# EasyEDA Pro project ProPrj_Avaota A1 八核 AIoT 开发板_2024-05-20.epro, board 点位_BOTTOM (continued)
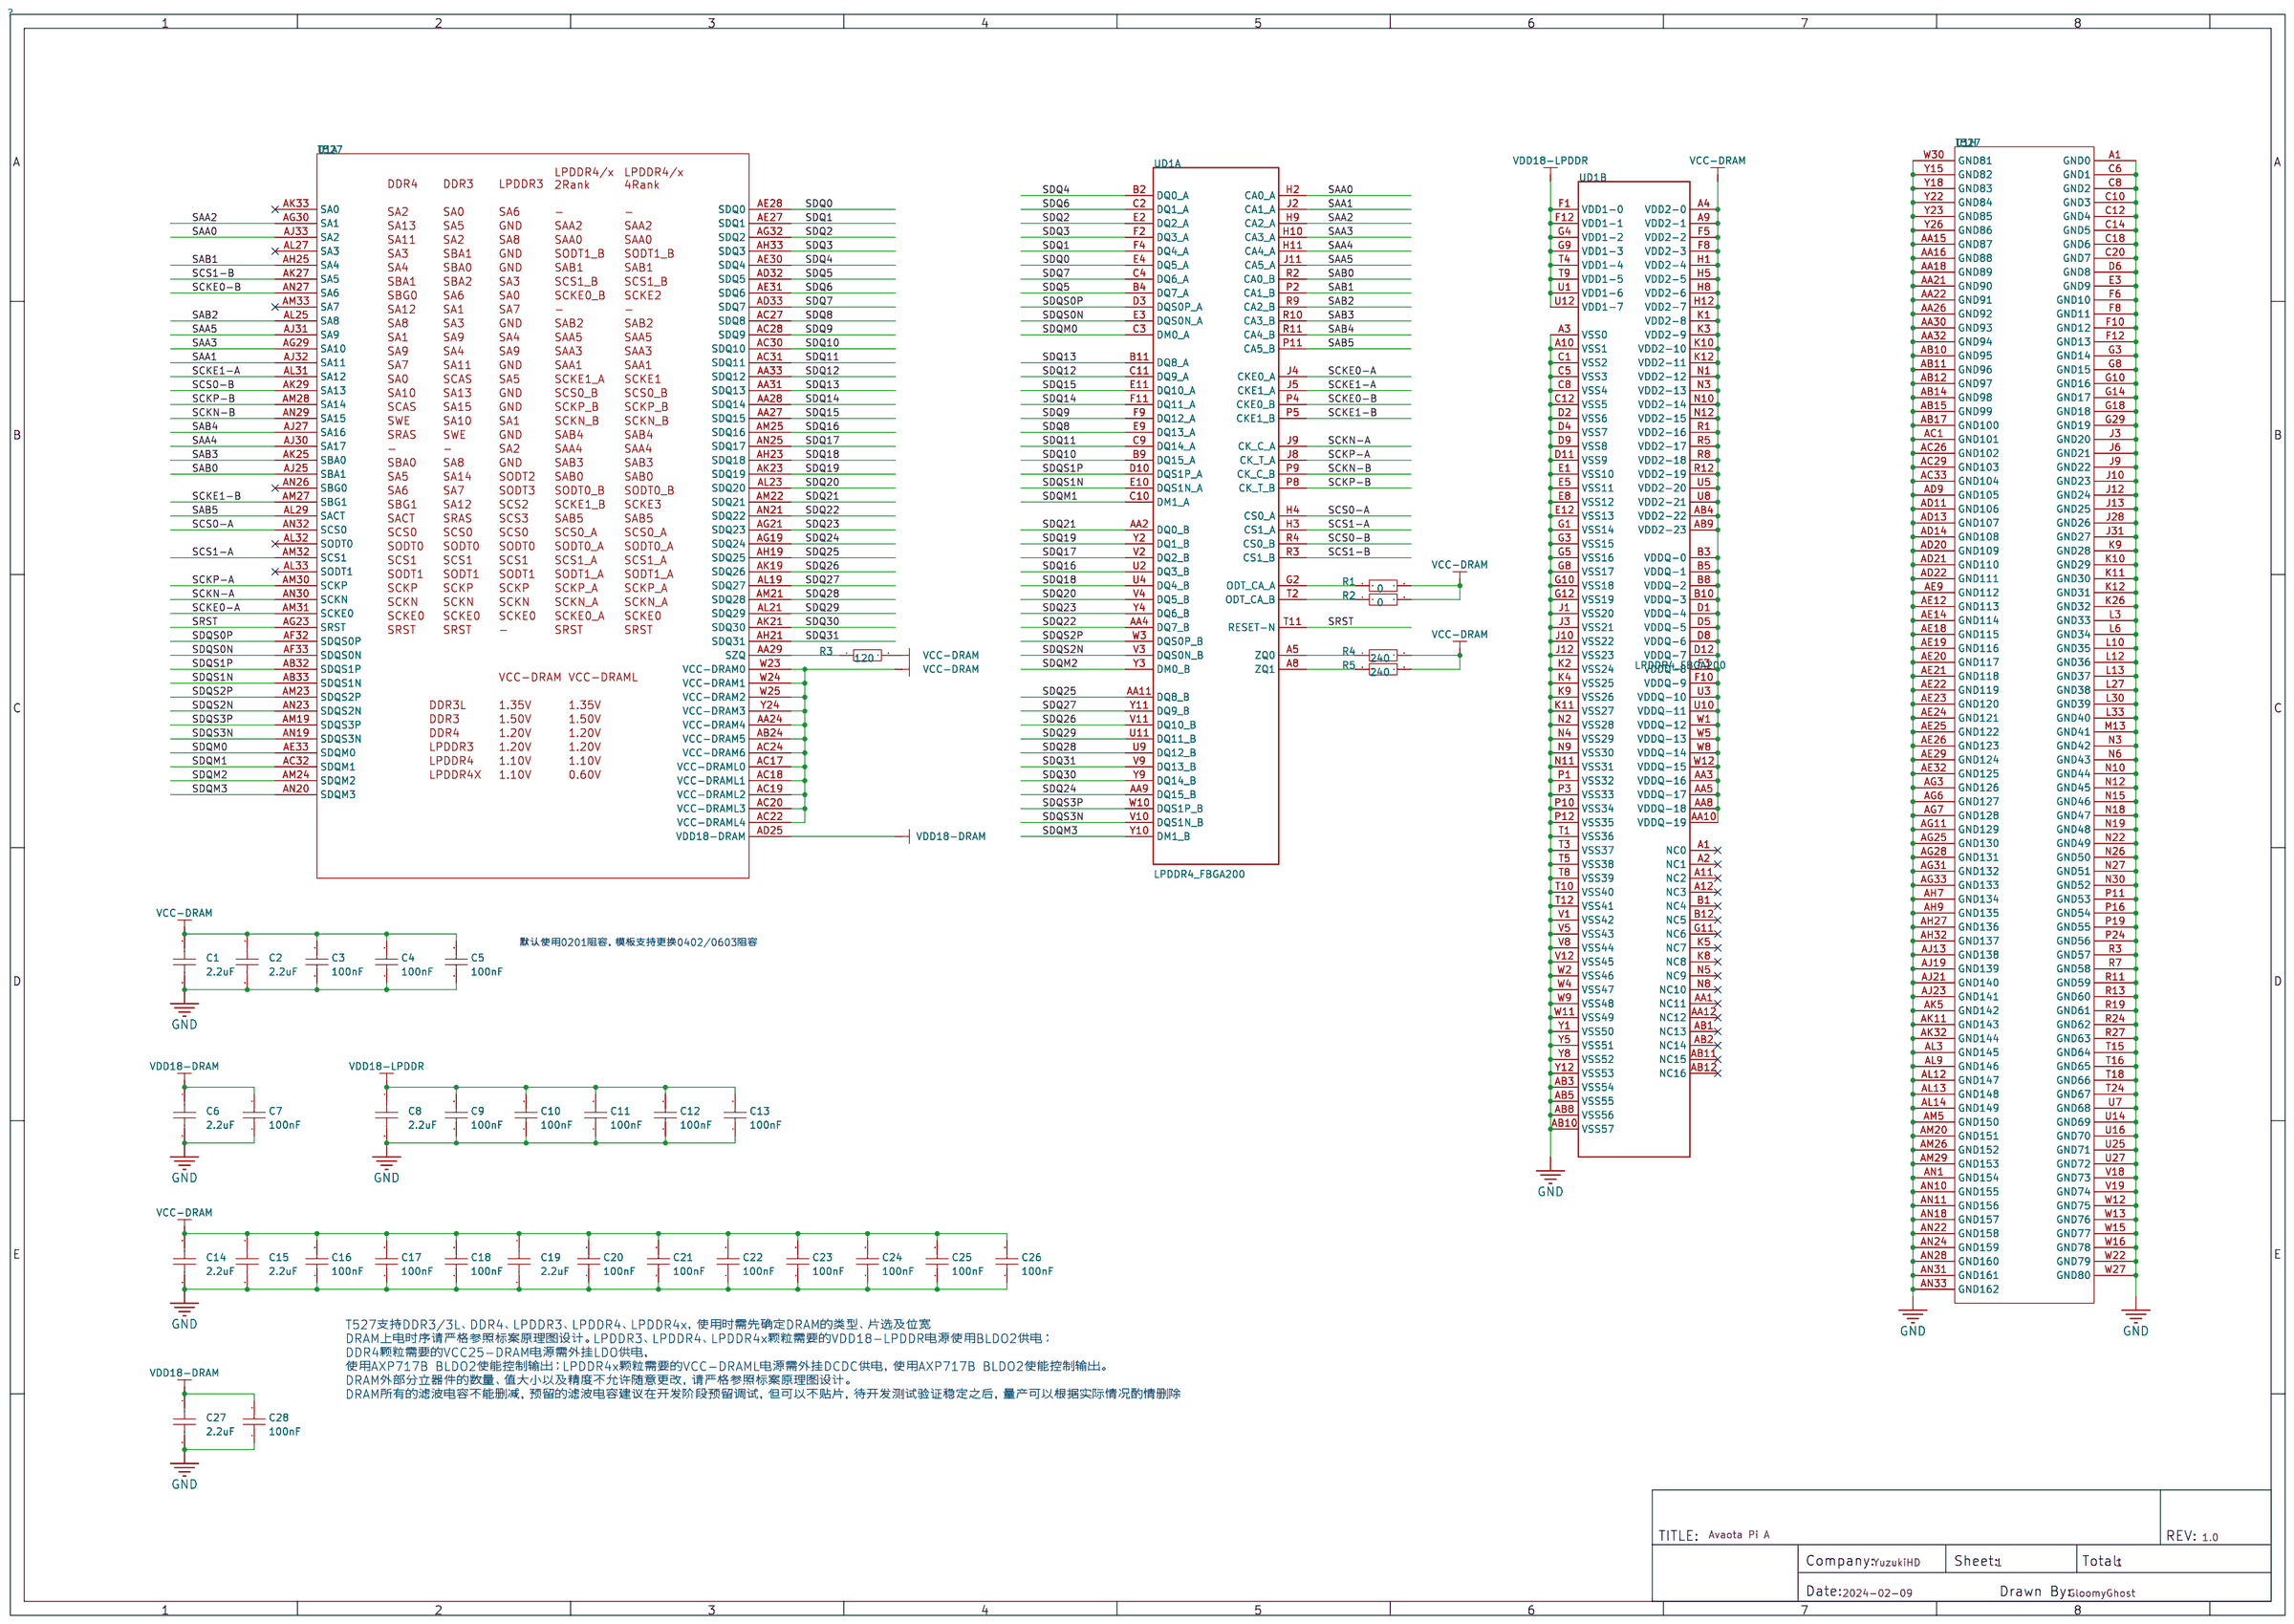
[diagram p0: schematic sheet]
## Nets (continued)
$6N6553: R57.2
$6N6556: R56.2
$8N2040: D16.1 R63.2 SIM1.11
$8N9148: R115.2 R116.1 U16.3
$8N11462: R126.1
$10N1043: C248.2
$11N1789: C255.2
$13N1231: R76.1 U11.8
$13N1478: U11.7
$13N1485: U11.6
$13N1600: C238.2 R65.1
$13N1603: C241.2 R66.1
$13N2020: C242.2 R67.2
$13N2077: C243.2 R68.2

Pads without a net: FPC1 34 45 46 47 48 49; FPC2 1

## Via types
v1: diameter 0.399, hole 0.299, Top Layer to Bottom Layer, 335 vias
v2: diameter 0.4, hole 0.3, Top Layer to Bottom Layer, 279 vias
v3: diameter 0.4, hole 0.299, Top Layer to Bottom Layer, 496 vias
v4: diameter 0.61, hole 0.305, Top Layer to Bottom Layer, 5 vias

## Routing (per net, layer and track width the routed paths; a pad name or vN(x,y) marks a point on that pad's centre or on a via; arc(x,y) is an arc through that point)
AGND: length 3
  Bottom Layer w0.152: v3(57.92,55.15) 57.99,55.08 C110.1 ; C110.1 C109.1 ; C110.1 58.52,54.64 C111.1 59.04,54.65 59.14,54.55 ; C108.1 59.14,54.55 ; 59.14,54.55 R28.2
GND: length 681.7
  GND1 w0.076: 35.18,42.21 35.22,42.21 35.25,42.24 35.51,42.24 35.53,42.21 35.63,42.21 ; 34.41,50.65 34.47,50.6 34.77,50.6 34.82,50.65
  内层2 w0.152: v1(71.91,37.59) 71.8,37.48 71.52,37.48 68,33.96 68,32.46 67.26,31.72 58.45,31.72 v1(53.01,26.29) ; v1(74.78,37.16) 74.24,36.63 71.73,36.63 68.83,33.73 68.83,32.06 67.67,30.89 58.79,30.89 54.44,26.54 v1(54.44,26.26) ; v1(73,30.89) 73,30.61 72.36,29.97 59.36,29.97 55.98,26.59 55.98,26.3 55.94,26.26 v1(55.88,26.26)
  内层4 w0.152: v1(45.97,21.9) 45.97,22.89 46.96,23.88 46.96,26.75 48.41,28.19 59.03,28.19 60.5,29.67 69.34,29.67 71.2,27.81 75.87,27.81 78.03,29.97 78.03,40.69 76.58,42.14 75.72,42.14 v3(75.69,42.16) ; v3(75.82,41.1) 76.1,41.1 77.22,39.98 77.22,30.56 75.34,28.68 71.6,28.68 69.75,30.53 59.84,30.53 58.34,29.03 48.08,29.03 46.08,27.03 46.08,24.33 44.58,22.83 v3(44.58,21.79) ; v3(75.87,43.13) 76.94,43.13 78.87,41.2 78.87,29.62 76.28,27.03 70.89,27.03 69.24,28.68 60.73,28.68 59.46,27.41 48.87,27.41 47.83,26.37 47.83,22.91 47.45,22.53 v3(47.45,21.79)
  Bottom Layer w0.102: C30.2 C46.2
  Bottom Layer w0.152: v1(58.98,53.14) 59.13,52.98 60.07,52.98 60.26,52.79 C112.1 ; C277.1 89.41,48.46 88.9,48.97 88.11,48.97 87.77,48.63 87.77,47.76 ; v3(53.11,56.34) 52.55,56.34 51.25,57.64 C183.1 51.25,58.87 C184.1 ; R55.1 R59.1 ; C225.2 41.85,32.42 C226.1 ; v1(27.43,17.37) 27.25,17.55 27.25,19.43 27.36,19.53 ; 63.38,47.55 63.41,47.58 C174.1 ; 63.38,47.55 C49.2 C50.2 62.43,47.52 C24.2 C19.2 61.44,47.6 v1(61.44,48.65) 61.85,49.05 C47.2 61.85,49.11 C208.1 ; 63.38,47.55 C187.1 ; R46.1 R44.1 66.94,45.71 v3(66.94,46.13) ; v3(61.95,53.15) 62.06,53.15 62.33,53.42 62.33,55.73 62.08,55.98 C107.1 ; C213.1 C211.1 65.12,51.71 C75.2 C76.2 C78.2 C77.2
  Bottom Layer w0.203: C46.2 10.16,50.06 v1(9.75,50.06) ; 90.5,18.8 89.38,17.68 v3(85.78,17.68) v3(83.79,17.68) ; 75.2,9.49 75.77,8.92 75.77,7.9 76.25,7.42 v3(76.25,7.24) ; v2(33.83,47.65) 34.1,47.92 34.1,48.21 v2(33.87,48.44) ; 40.32,47.9 40.32,48.34 v2(40.23,48.43)
  Bottom Layer w0.254: 40.51,39.27 40.54,39.3 40.54,39.75 v2(40.44,39.85) ; C215.1 C216.1 65.18,51.13 C188.1 ; C215.1 C104.1 ; C215.1 C68.2 ; C173.1 63.41,49.11 v1(62.94,48.65) 63.41,48.65 C174.1 ; v2(36.23,50.43) 36.09,50.57 36.09,50.99 ; C26.2 4,54.81 3.99,54.82 ; v2(38.45,44.32) 38.35,44.22 37.99,44.22 ; 51.81,43.63 51.66,43.79 51.61,43.79 ; 51.81,43.63 51.81,43.84 52.55,43.84 52.58,43.87 ; 51.81,43.63 51.81,43.51 v2(52.09,43.23) ; C176.1 65.44,45.54 64.94,45.54 ; 34.75,54.27 35.11,54.27 v2(35.25,54.41) ; FPC2.25 85.55,40.46 84.51,41.5 84.51,49.63 79.93,54.2 75.26,54.2 74.52,54.94 v1(74.52,55.12) ; 40.03,50.32 40.03,50.78 v2(40.21,50.95) ; 39.88,45.46 39.88,45.52 v2(40.21,45.85) ; C175.1 64.94,45.54 ; 64.94,45.54 64.99,45.49 C201.1 ; 64.94,45.54 C185.1 C186.1 ; 58.32,52.65 C113.1 ; 58.32,52.65 v1(57.45,52.65) 57.54,52.57 C102.1 ; 58.32,52.65 57.94,53.04 57.94,53.48 C103.1 ; v1(56.92,55.14) 56.59,55.14 56.48,55.03 C172.1 ; 42.57,51.84 42.57,51.47 v2(42.72,51.32) ; v2(35.35,45.85) 35.61,45.85 36.02,46.26 36.07,46.26 ; v1(80.85,49.1) 80.85,49.02 80.62,48.79 80.62,46.08 v1(81.1,45.59) 81.1,39.24 82.78,37.57 82.78,34.06 84.88,31.96 FPC2.8 ; v3(67.61,17.7) v3(65.58,17.7) 61.59,17.7 v3(61.06,18.24) ; v2(60.45,43.15) 60.5,43.21 60.5,43.43 60.28,43.65 59.94,43.65 ; 63.32,43.57 63.22,43.57 63.04,43.76 62.68,43.76 C91.1 62.55,43.66 C164.1 C163.1 C227.1 ; v2(32.99,41.27) 33.29,40.97 33.29,40.66 ; 38.22,49.34 38.66,49.78 v2(38.66,49.88) ; 38.21,43.26 37.82,43.65 v2(37.82,43.74) ; C41.2 59.44,46.51 v1(59.44,45.14) ; C94.1 v1(54.43,51.66) ; v1(30.18,18.9) 36.63,25.35 45.09,25.35 48.74,29.01 76.1,29.01 78.89,31.8 78.89,36.55 76.33,39.12 74.7,39.12 73.18,40.64 73.18,43.36 v1(72.31,44.22) ; 58.95,43.65 58.42,43.65 58.42,42.87 58.34,42.8 57.97,42.8 57.91,42.74 ; 36.1,42.06 35.58,42.06 35.33,41.81 34.64,41.81 v2(34.52,41.94) ; C40.2 60.86,48.31 C39.2 ; v2(42.58,43.05) 42.73,43.2 43.2,43.2 ; 40.37,41.91 40.37,41.52 v2(40.18,41.33) ; C58.2 C57.2 C67.2 ; C202.1 55.17,54.65 v1(54.44,54.65) 54.31,54.78 C182.1 C181.1 ; 35.42,44.4 35.42,44.01 v2(35.33,43.92) ; 57.91,42.74 v2(57.91,42.42) ; 57.91,42.74 57.91,43.06 C133.1 ; 43.33,44.22 43.23,44.22 v2(42.85,43.84) 42.4,43.84 42.38,43.87 ; v1(75.9,33.91) 76.89,32.92 76.89,31.32 75.49,29.92 48.18,29.92 44.55,26.29 35.79,26.29 28.7,19.2 28.7,18.9 ; 27.36,19.53 35.28,27.46 44.27,27.46 47.5,30.68 66.88,30.68 71.22,35.03 v3(72.11,35.03) ; v1(60.99,44.15) 60.99,44.56 ; 60.99,44.56 60.99,45.03 C20.2 ; 60.99,44.56 61.95,44.56 C22.2 C21.2 ; C13.2 56.76,50.27 C14.2 56.81,50.23 C90.1 C93.1 57.88,49.2 57.89,49.21 58.3,49.21 58.62,48.89 C84.2 C83.2 C86.2 61.2,48.89 v1(61.44,48.65) ; v1(72.54,52.48) 79.22,52.48 v1(80.62,51.08) 82.58,49.12 v1(82.58,45.59) 82.55,45.57 82.55,39.6 83.9,38.25 83.9,35.05 85.49,33.46 FPC2.11 ; v3(97.71,60.22) 98.5,61.01 SIM1.6 ; v1(73.53,53.47) 79.63,53.47 v1(80.52,52.58) 83.62,49.48 83.62,40.54 84.48,39.68 93.52,39.68 93.74,39.46 FPC2.23 ; C106.1 60.03,55.99 59.72,55.68 59.72,55.02 R28.1 ; v2(40.84,54.56) 40.56,54.28 39.52,54.28 ; C42.2 4.77,51.94 C29.2 C79.1 ; C117.2 v2(34.59,44.48) ; v1(38.73,33.22) 38.82,33.13 C230.1
  Bottom Layer w0.508: 96.44,25.28 96.44,23.84 96.29,23.69
  Bottom Layer w0.762: 75.18,9.51 59.18,9.51 ; 75.18,9.51 72.79,11.9 72.79,12.81 ; 75.18,9.51 75.2,9.49 93.45,9.49 91.06,11.88 91.06,12.79
  vias: v1(5.31,56.85) v1(6.6,65.96) v1(6.6,65.18) v1(6.66,64.47) v1(6.66,63.88) v1(6.76,66.5) v1(6.68,63.04) v1(6.68,62.26) v1(7.04,61.75) v1(7.24,66.68) v1(7.49,52.96) v1(7.49,52.25) v1(7.49,51.46) v1(7.49,50.7) v1(7.9,61.62) v1(8.13,66.75) v1(8.31,52.96) v1(8.31,52.25) v1(8.31,51.46) v1(8.31,50.7) v1(8.81,61.62) v1(8.94,66.8) v1(9.12,52.96) v1(9.12,52.25) v1(9.12,51.46) v1(9.47,38.53) v1(9.78,61.7) v1(9.93,66.5) v1(9.93,52.96) v1(9.93,52.25) v1(9.93,51.46) v1(10.16,65.58) v1(10.46,62.15) v1(10.67,66.27) v1(10.59,63.32) v1(10.77,65.51) v1(10.97,62.66) v1(11.13,63.6) v1(11.46,65.48) v1(11.51,63.02) v1(11.61,66.17) v1(11.61,64.77) v1(11.91,63.63) v1(12.12,65.51) v1(12.14,64.74) v1(12.17,63.02) v1(12.5,63.65) v1(12.85,65.43) v1(12.93,62.99) v1(13.16,64.77) v1(13.33,63.7) v1(13.51,65.46) v1(13.59,63.02) v1(13.94,64.74) v1(14,63.73) v1(14.27,65.46) v1(14.43,63.02) v1(14.55,64.77) v1(14.6,63.7) v1(14.99,47.83) v1(14.99,47) v1(17.53,41.33) v1(20.96,59.26) v1(22.22,59.26) v1(28.7,18.81) v1(34.44,36.65) v1(36.91,36.6) v1(42.01,19.61) v1(49.38,26.26) v1(55.94,52.15) v1(57.78,26.26) v1(62.2,20.54) v1(65.43,52.63) v1(65.38,23.56) v1(65.38,22.85) v1(65.38,22.06) v1(65.38,21.3) v1(65.91,52.63) v1(66.19,23.56) v1(66.19,22.85) v1(66.19,22.06) v1(66.19,21.3) v1(66.42,51.13) v1(66.93,52.12) v1(67.01,23.56) v1(67.01,22.85) v1(67.01,22.06) v1(67.01,21.3) v1(67.82,23.56) v1(67.82,22.85) v1(67.82,22.06) v1(67.82,21.3) v1(69.37,37.9) v1(69.8,37.11) v1(71.25,34.65) v1(72.87,34.21) v1(73.46,35.66) v1(73.63,33.12) v1(73.63,31.72) v1(75.08,36.35) v1(78.33,23.01) v1(79.3,49.78) v1(80.75,20.38) v1(83.24,27.58) v1(83.54,23.29) v1(83.54,22.58) v1(83.54,21.79) v1(83.54,21.03) v1(84.35,23.29) v1(84.35,22.58) v1(84.35,21.79) v1(84.35,21.03) v1(85.16,23.29) v1(85.16,22.58) v1(85.16,21.79) v1(85.16,21.03) v1(85.98,23.29) v1(85.98,22.58) v1(85.98,21.79) v1(85.98,21.03) v1(90.02,46.18) v1(90.68,36.47) v2(32.74,51.62) v2(32.76,49.71) v2(32.76,48.67) v2(32.81,42.77) v2(32.93,44.26) v2(33.74,49.71) v2(33.81,52.3) v2(33.78,46.71) v2(33.77,45.91) v2(33.81,44.47) v2(33.78,41.88) v2(34.59,49.71) v2(34.63,40.62) v2(35.38,50.42) v2(36.17,47.33) v2(36.22,52.35) v2(36.47,54.38) v2(37.06,48.41) v2(37.09,51.3) v2(37.16,42.87) v2(37.36,54.08) v2(37.59,45.97) v2(37.74,44.73) v2(37.72,41.33) v2(38.22,50.72) v2(38.4,53.26) v2(38.56,41.33) v2(39.44,46.3) v2(40.21,49.61) v2(40.23,44.53) v2(41.68,48.29) v2(41.73,46) v2(41.78,52.4) v2(41.82,41.98) v2(42.65,52.43) v2(42.8,50.24) v2(43.05,41.93) v2(43.2,45.5) v2(44.36,48.74) v2(48.36,47.8) v2(49.07,45.47) v2(49.6,46.65) v2(50.8,45.47) v2(51.74,47.73) v2(52.19,41.81) v2(52.67,39.03) v2(52.79,42.53) v2(52.91,44.78) v2(53.34,39.03) v2(54.46,39.01) v2(55.49,46.69) v2(55.5,45.66) v2(55.5,44.7) v2(56.07,39) v2(56.59,43.67) v2(56.94,41.66) v2(58.16,38.96) v2(59.9,41.59) v3(7.29,47.37) v3(8.47,47.04) v3(9.44,48.32) v3(15.85,43.49) v3(15.85,42.61) v3(16.25,43.01) v3(16.71,43.49) v3(16.71,42.61) v3(44.75,19.63) v3(47.45,19.76) v3(50.14,22.33) v3(51.46,24.56) v3(51.64,50.72) v3(54.44,49.65) v3(55.44,49.68) v3(55.88,22.38) v3(55.88,22.38) v3(57.44,47.64) v3(57.44,47.15) v3(57.44,46.64) v3(57.44,46.15) v3(57.44,45.64) v3(57.44,45.15) v3(57.44,44.65) v3(57.44,44.15) v3(57.56,59.79) v3(58.23,56.63) v3(59.23,59.82) v3(62.2,56.85) v3(62.76,22.56) v3(62.94,53.09) v3(63.55,57.53) v3(63.93,53.65) v3(63.95,41.65) v3(64.08,38.86) v3(64.99,57.47) v3(65.94,56.79) v3(66.95,55.14) v3(66.95,53.14) v3(66.93,42.14) v3(68.45,54.15) v3(69.67,56.41) v3(69.85,40.39) v3(70.08,49.33) v3(70.16,43.18) v3(70.24,47.41) v3(70.18,45.3) v3(70.35,51.58) v3(71.09,46.51) v3(75.64,4.19) v3(76.33,1.14) v3(76.89,4.19) v3(85.47,54.43) v3(85.47,53.85) v3(85.83,57) v3(85.83,56.41)
VBUS: length 305
  内层4 w0.508: v1(97.61,22.25) 97.61,22.78 95.86,24.54 80.87,24.54 78.66,22.33 74.88,22.33 73.13,24.08 68.91,24.08 68.05,24.94 61.95,24.94 60.83,23.83 59.41,23.83 57.38,21.79 51.33,21.79 50.14,20.6 42.01,20.6 v1(38.49,17.08) v1(38.16,16.75)
  Inner5 w0.508: v3(96.72,66.88) v3(96.27,66.88) 95.81,66.42 95.81,62.92 96.29,62.43 96.29,55.91 95.05,54.66 95.05,51.16 95.71,50.5 95.71,48.46 97.61,46.56 v1(97.61,22.25) ; v1(1.85,16.28) 3.81,18.24 3.81,19.1 ; 10.44,73.23 7.9,73.23 6.22,71.55 6.22,69.93
  Inner5 w1.27: 3.2,37.72 5.77,40.28 5.89,40.28 ; 3.2,37.72 2.69,38.21 ; 3.2,37.72 3.2,20.17 4.14,19.23 4.14,16 6.5,13.64 17.48,13.64 18.59,14.76 22.1,14.76 ; v4(10.77,43.56) 10.74,43.59 v4(9.93,43.59) ; v4(10.77,43.56) 9.58,42.37 ; v4(10.77,43.56) v4(10.77,42.7) 10.77,42.67 10.79,42.65 8.43,40.28 ; 8.43,40.28 7.49,40.28 ; 8.43,40.28 7.39,39.24 v1(7.39,37.44) ; 7.49,40.28 5.89,40.28 ; 7.49,40.28 9.58,42.37 ; 5.89,40.28 9.19,43.59 v4(9.93,43.59) ; 9.58,42.37 9.58,43.23 v4(9.93,43.59) ; 9.58,42.37 9.58,41.96 ; 10.24,43.15 10.24,43.28 v4(9.93,43.59) ; 2.49,38.3 2.49,51.61 2.15,51.95 2.15,54.71 2.9,55.45 2.9,65.32 ; 21.89,14.91 22.71,15.72 35.79,15.72 36.47,15.04 ; 6.22,69.93 6.22,68.65 2.9,65.32 ; 2.9,65.32 2.9,65.46 2.87,65.48
  Bottom Layer w0.203: v3(39.57,22.25) v3(39.57,23.47)
  Bottom Layer w0.254: FPC1.1 7.05,37.78 v1(7.39,37.44) ; v1(7.39,37.44) 7.23,37.28 FPC1.2 ; v1(7.39,37.44) C247.2
  Bottom Layer w0.508: 97.46,25.28 97.56,25.18 U11.3 97.61,23.64 v1(97.61,22.25) ; 25.53,10.44 26.01,9.96 26.01,7.71 25.53,7.24 ; v1(38.49,17.08) 39.57,18.16 v3(39.57,22.25) ; v1(38.16,16.75) v1(36.65,15.24) 36.45,15.04 v1(36.24,14.83)
  Bottom Layer w0.762: 12.19,41.63 12.19,41.58 12.31,41.46 ; 12.19,41.63 12.19,42.49 11.13,43.56 v4(10.77,43.56) v4(10.77,42.7) 11.84,41.63 12.19,41.63 ; 12.19,41.63 12.31,41.51 12.31,41.46 ; v1(17.22,36.07) v1(17.22,36.58) 17.22,37.31 16.61,37.92 15.85,37.92 12.31,41.46
  Bottom Layer w1.27: C294.2 38.15,13.34 38.15,3.45 36.6,1.91 28.93,1.91 25.53,5.3 25.53,7.24
  vias: v1(4.62,50.32) v1(35.89,15.52) v1(36.98,14.66) v3(4.12,50.29) v3(4.12,49.76) v3(4.12,49.23) v3(4.12,48.66) v3(5.13,50.37) v4(9.09,43.6) v4(9.88,42.79)
VCC-3V3-BLK: length 2.1
  Bottom Layer w0.254: C277.2 88.77,46.33 R126.2 88.72,47.76 88.72,47.76
VCC-LDO-RTC: length 66.2
  内层2 w0.152: v1(6.4,50.24) 6.27,50.11 v3(6.27,47.09)
  Inner5 w0.381: v1(14.53,53.95) 14.22,53.95 13.59,54.58 12.55,54.58 12.42,54.71 6.55,54.71 v1(5.47,55.79)
  Bottom Layer w0.152: v1(6.4,50.24) 7.04,50.88 7.04,55.3 6.88,55.45 5.82,55.45 v1(5.47,55.79)
  Bottom Layer w0.203: v1(57.94,50.67) 57.37,51.24 51.55,51.24 47.29,55.5 16.08,55.5 v1(14.53,53.95)
VDD-CPUBFB: length 70
  内层2 w0.254: v3(17.37,44.68) 18.59,44.68 27.1,53.19 27.1,56.08 31.9,60.88 52.58,60.88 55.63,57.84 55.63,57.48 56.57,56.54 57.18,56.54 59.82,53.9 60.88,53.9 61.29,53.49 61.29,52.63 61.9,52.02 61.95,52.02 61.95,51.33 61.49,50.88 61.49,50.37 61.72,50.14 62.31,50.14 63.37,49.07 63.37,47.37 63.96,46.79 63.96,46.48 63.12,45.65 v1(62.44,45.65)
  Bottom Layer w0.254: v3(17.65,41.86) 17.65,42.88 18.26,43.49 18.26,44.22 17.81,44.68 v3(17.37,44.68)
VDD-CPULFB: length 61.3
  Inner5 w0.254: v3(10.69,48.29) 10.39,47.98 10.39,45.85 11.38,44.86 13.61,44.86 17.93,49.17 25.6,49.17 32.56,56.13 46.25,56.13 51.23,51.16 51.82,51.16 52.1,50.88 52.1,50.29 52.68,49.71 53.62,49.71 54.15,49.17 57.61,49.17 57.94,48.84 58.42,48.84 58.85,48.41 58.85,47.42 59.13,47.14 v1(59.44,47.14)
VDD-DNRFB: length 50.8
  VCC w0.254: v1(58.94,50.15) 58.02,49.23 52.48,49.23 45.85,55.85 31.88,55.85 22.4,46.38 15.8,46.38 v1(15.34,45.92)
VDD-SYSFB: length 64.6
  内层4 w0.254: v1(62.94,48.16) 62.94,48.01 62.56,47.62 60.27,47.62 58.75,49.15 52.55,49.15 45.47,56.24 20.07,56.24 16.87,59.44 14.55,59.44 13.94,60.05 10.85,60.05 9.09,58.29 9.09,57.05 8.05,56.01 v3(8.05,54.15)
323-DCDC1/2: length 6.9
  Bottom Layer w0.254: v1(61.44,45.65) v1(61.44,46.66) ; v1(61.44,45.65) v1(61.94,45.65) ; v1(61.44,45.65) C23.1 ; v1(61.44,46.66) v1(60.93,46.66) 60.96,46.63 v1(60.96,46.15) 60.96,45.71 60.9,45.64 ; v1(61.44,46.66) 61.44,46.88 C19.1 C24.1 61.94,46.94 v1(61.94,45.65) ; v1(61.94,45.65) 61.95,45.64 C22.1 62.5,45.12 62.51,45.14
  vias: v3(21.97,45.01) v3(21.97,44.36) v3(21.97,43.69) v3(21.97,43.05) v3(21.97,42.48) v3(21.97,41.76) v3(22.05,41.05) v3(22.57,41.05)
323-DCDC3: length 3
  Bottom Layer w0.254: C85.1 59.94,49.53 v1(59.94,50.15) ; C86.1 60.12,49.46 v1(59.94,49.64) 59.77,49.46 C83.1 ; C84.1 C83.1 ; C83.1 59.44,49.51 v1(59.44,49.64) v1(59.44,50.15)
  vias: v3(18.21,48.49) v3(18.21,47.89) v3(18.73,47.89) v3(18.72,47.34)
ADCIN0: length 4.1
  Bottom Layer w0.152: C106.2 60.67,55.42 R26.2 60.83,55.33 60.83,52.54
  Bottom Layer w0.178: v3(60.44,52.15) 60.83,52.54
ADCIN1: length 4.7
  Bottom Layer w0.178: C107.2 61.28,55.94 R27.2 61.28,55.21 61.14,55.07 61.14,52.27 60.51,51.65 v3(60.44,51.65)
ALDO3: length 67.8
  VCC w0.152: v1(12.92,49.53) 12.47,49.97 12.47,52.35 11.96,52.86 11.96,53.75 11.13,54.58 7.39,54.58 6.81,54 6.81,50.09 6.43,49.71 6.43,49.3 6.58,49.15 6.58,48.06 5.99,47.47 5.53,47.47 v3(5.18,47.12)
  Inner5 w0.457: v1(41.5,62.05) 29.78,62.05 22.92,55.19 20.6,55.19 18.62,53.21 14.79,53.21 13.37,51.79 12.73,51.79 12.14,51.21 12.14,49.96 12.57,49.53 v1(12.92,49.53)
  Bottom Layer w0.254: v1(49.53,61.54) 49.5,61.52 49.5,60.17 50.6,59.08 50.6,57.66 52.15,56.11 52.15,55.47 53.62,54 53.92,54 54.15,54.23 54.79,54.23 54.91,54.1 55.19,54.1 55.45,53.85 55.45,53.49 56.44,52.5 v1(56.44,52.15)
  vias: v1(42.11,62.05) v1(49.15,61.95)
ALDO4: length 95.5
  内层2 w0.254: v3(56.97,59.79) 56.97,59.56 57.25,59.28 58.22,59.28 58.67,59.74 v3(58.67,59.84)
  VCC w0.381: v3(57.94,44.15) 57.94,44.91 58.19,45.16 58.72,45.16 58.93,45.36 58.93,49.35 ; 58.93,49.35 59.21,49.07 60.35,49.07 60.93,49.66 v1(60.93,51.43) 60.93,52.65 v3(60.44,53.15) 59.68,53.15 58.85,53.98 58.85,57 58.39,57.46 58.39,58.47 58.67,58.75 v3(58.67,59.84) 58.67,60.05 58.98,60.35 59.46,60.35 59.79,60.02 v3(59.79,59.82) ; 58.93,49.35 57.74,48.16 57.2,48.16 56.74,48.62 v1(56.44,48.62)
  Inner5 w0.457: v3(60.44,53.15) 60.44,54.26 58.7,56.01 56.87,56.01 54.53,58.34 48.77,58.34 45.82,61.29 30.11,61.29 23.3,54.48 20.8,54.48 18.85,52.53 ; 18.77,52.48 15.09,52.48 13.87,51.26 13.87,50.57 13.39,50.09 12.92,50.09 12.92,50.09
  Bottom Layer w0.127: R24.2 60.19,51.26 60.76,51.26 v1(60.93,51.43)
  Bottom Layer w0.152: 59.72,53.92 60.44,53.2 v3(60.44,53.15)
  Bottom Layer w0.203: v3(60.44,53.15) 60.25,53.34 59.72,53.34
  Bottom Layer w0.254: 57.94,44.02 v3(57.94,44.15) ; 57.94,44.02 57.94,43.67 C133.2 ; 57.94,44.02 57.63,43.71 57.21,43.71 56.7,44.22 52.72,44.22 52.58,44.37 ; 51.61,44.36 51.62,44.37 52.58,44.37 ; 52.58,44.37 52.55,44.34 ; v1(56.44,48.62) 56.44,48.71 56.24,48.91 C93.2 C90.2
  vias: v1(12.92,50.09)
ALDO-OUT: length 0.4
  Bottom Layer w0.178: v3(57.44,53.15) 57.43,53.14 57.43,53.14 C103.2
AP-NMI: length 79.5
  VCC w0.102: v1(7.57,54.08) 7.07,53.57 7.07,49.96 v1(7.44,49.58)
  VCC w0.152: v1(7.39,48.01) 7.39,49.53 v1(7.44,49.58)
  Bottom Layer w0.102: v3(52.81,51.63) 52.79,51.61 51.99,51.61 47.65,55.96 43.84,55.96 42.27,57.53 36.37,57.53 35.69,56.85 13.59,56.85 11.91,55.17 11.91,50.62 11.71,50.42 9.6,50.42 9.09,49.91 7.77,49.91 v1(7.44,49.58) 7.09,49.23 6.53,49.23 5.77,49.99 4.98,49.99 4.52,49.53 4.52,48.77 5.26,48.03 5.26,47.85 4.8,47.4 4.8,46.91 5.28,46.43 5.28,45.8 6.66,44.42 12.27,44.42 13.28,43.41 13.28,41.88 v3(13.41,41.76)
  Bottom Layer w0.254: C94.2 53.28,51.63 v3(52.81,51.63)
AP-RESET: length 81.2
  VCC w0.127: v1(6.86,49.61) 6.83,49.58 6.83,46.2 8.84,44.2 14.5,44.2 v1(14.6,44.3)
  VCC w0.152: v1(22.78,38.89) 17.83,38.89 16.26,40.46 v3(16.26,41.02)
  Bottom Layer w0.102: v1(6.86,49.61) 7.44,50.19 9.04,50.19 9.47,50.62 11.48,50.62 11.68,50.83 11.68,55.4 13.41,57.12 35.51,57.12 36.25,57.86 42.37,57.86 43.99,56.24 47.78,56.24 52.15,51.87 52.55,51.87 52.65,51.97 52.7,51.97 52.88,52.15 54.66,52.15 55.14,51.66 55.4,51.66
  Bottom Layer w0.127: v1(14.6,44.3) 14.6,42.67 v3(16.26,41.02)
  vias: v3(55.45,51.64)
AP-WAKE-BT: length 49.7
  Inner5 w0.102: v3(61.95,54.65) 60.8,54.65 57.84,57.61 56.34,57.61 55.07,58.88 48.97,58.88 45.14,62.71 22.07,62.71 19.3,59.94 17.6,59.94 v3(17.02,60.53)
BLDO1: length 90.3
  VCC w0.381: v1(56.92,53.62) 56.44,53.14 54.2,53.14 53.75,53.59
  VCC w0.508: 53.75,53.7 47.29,60.15 30.4,60.15 v1(28.68,58.42) 24.94,54.69 14.49,54.69 13.99,54.18 13.99,51.25 13.39,50.65 v1(12.92,50.65)
  Inner5 w0.254: 61.87,52.15 61.42,52.15 60.91,52.65 58.22,52.65 57.91,52.96 57.91,53.31 57.51,53.72 57.02,53.72 v1(56.92,53.62) ; 61.87,52.15 62.07,52.15 ; 61.87,52.15 62.66,51.36 62.99,51.36 64.21,50.14 64.57,50.14 64.9,49.81 64.9,47.5 64.44,47.04 64.44,44.88 64.08,44.53 63.55,44.53 v1(63.42,44.65) ; 62.07,52.15 63.12,52.15 63.44,52.47 v3(63.44,52.58) ; 62.07,52.15 62.46,52.54 v3(62.46,52.68)
  Bottom Layer w0.254: v3(63.44,52.58) 63.45,52.58 C165.2 ; C171.2 C166.2 63.32,44.55 v1(63.42,44.65) ; C172.2 56.44,53.95 56.77,53.62 v1(56.92,53.62)
  Bottom Layer w0.508: v1(14.12,61.19) 14.6,61.19 17.81,57.99 v1(24.71,57.99) 25.15,58.42 v1(28.68,58.42)
BLDO2: length 42.9
  内层4 w0.508: v2(33.1,50.39) 32.48,50.39 31.57,49.48 17.83,49.48 15.75,51.56 v1(15.06,51.56) 13.27,51.56 v1(12.92,51.21)
  Bottom Layer w0.152: v1(15.06,51.56) 14.48,50.98 14.48,45.36 15.06,44.78 15.06,42.8 16.64,41.22 v3(16.64,40.64)
  Bottom Layer w0.203: 41.81,43.87 41.81,44.25 41.12,44.93 39.8,44.93 39.8,44.19 v2(39.38,43.77)
  Bottom Layer w0.254: v2(32.87,43.55) 32.83,43.55 ; v2(35.46,49.7) 35.45,49.7 35.02,49.28 34.39,49.28 34.16,49.51 34.16,49.96 33.78,50.34 33.14,50.34 v2(33.1,50.39) ; 38.78,43.26 39.3,43.77 v2(39.38,43.77) ; 41.81,43.87 v2(41.81,43.21) ; 35.99,44.4 35.99,44.2 v2(36.23,43.96)
  vias: v2(39.39,50.32) v2(41.83,50.36)
BLDO3: length 78.3
  内层2 w0.254: v1(70.36,52.73) 70,52.73 68.94,51.66 65.63,51.66 65.1,51.13 v1(63.96,51.13)
  VCC w0.381: v3(55.93,53.95) 55.75,54.13 54.1,54.13 47.4,60.83 30.1,60.83 24.56,55.3 14.25,55.3 13.41,54.46 13.41,52.82 v1(12.92,52.32)
  Bottom Layer w0.127: C187.2 64.36,47.55
  Bottom Layer w0.254: R127.1 R128.1 70.28,52.81 v1(70.36,52.73) ; v3(55.93,53.95) 55.62,54.26 C202.2 ; C201.2 64.01,45.03 v1(63.96,45.09)
  Bottom Layer w0.381: v3(55.93,53.95) 55.93,53.7 56.95,52.68 56.95,51.89 57.18,51.66 57.99,51.66 59,50.65 60.6,50.65 61.11,50.14 C208.2 63.96,50.14
  Bottom Layer w0.457: 64.52,47.52 63.63,46.63 v1(63.53,46.63) 63.83,46.33 C186.2 C185.2 63.83,45.21 v1(63.96,45.09) ; v1(63.96,51.13) 63.96,50.14 v1(64.44,49.66) 64.72,49.66 65,49.38 65,48.18 64.36,47.55
BT-RESETN: length 12.8
  Bottom Layer w0.102: v1(26.06,65.19) 28.86,65.19 35.41,58.65 35.53,58.65 v3(35.94,58.24)
BT-WAKE-AP: length 50.5
  Inner5 w0.102: v3(61.95,54.15) 62.31,54.5 62.31,54.79 62.1,54.99 60.86,54.99 57.96,57.89 56.44,57.89 55.14,59.18 49.07,59.18 45.19,63.07 22.02,63.07 19.15,60.2 17.81,60.2 17.5,60.5 v3(17.5,60.71)
CAN-RX0: length 116.1
  内层2 w0.102: v3(55.42,48.59) 55.42,48.83 55.18,49.07 54.14,49.07 51.84,51.37 51.84,54.43 49.86,56.41 46.96,56.41 46,57.38 45.77,57.38 v1(45.39,57.76)
  内层4 w0.102: v1(98.58,21.51) 98.58,22.99 95.73,25.83 94.49,25.83 87.25,33.07 87.25,52.25 88.72,53.72 88.72,56.97 86.11,59.59 62.28,59.59 60.91,60.96 57.56,60.96 52.43,66.09 45.42,66.09 v1(44.17,64.85)
  Bottom Layer w0.102: U11.4 98.83,21.77 v1(98.58,21.51) ; v1(44.17,64.85) 44.17,64.14 44.4,63.91 44.4,60.12 45.57,58.95 45.57,57.94 v1(45.39,57.76)
CAN-TX0: length 108.5
  内层2 w0.102: v1(45.97,57.79) 45.98,57.79 47.1,56.67 50.04,56.67 52.1,54.61 52.1,51.46 54.25,49.31 55.34,49.31 55.93,48.72 v3(55.93,48.59)
  内层4 w0.102: v1(94.84,25.4) 94.46,25.4 86.89,32.97 86.89,52.35 88.42,53.87 88.42,56.87 85.95,59.33 62.13,59.33 60.78,60.68 57.35,60.68 52.25,65.79 45.67,65.79 v1(44.7,64.82)
  Bottom Layer w0.102: v1(94.84,25.4) 95.02,25.22 U11.1 ; v1(44.7,64.82) 44.7,60.27 45.97,59 v1(45.97,57.79)
CLDO1: length 74.4
  Bottom Layer w0.508: 41.18,31.67 42.22,31.67 44.98,34.44 57.07,34.44 60.55,37.92 60.55,39.95 61.44,40.84 v3(61.44,43.64) ; 41.18,31.67 36.3,31.67 35.59,32.39 v3(35.59,34.52) 35.59,34.93 35.03,35.48 20.62,35.48 13.79,42.32 13.79,52.48 v3(12.88,53.39) ; 41.18,31.67 41.22,31.72 v3(41.22,33.3)
CLDO2: length 113.9
  VCC w0.254: v1(62.03,41.91) 62.03,38.53 57.36,33.87 38.59,33.87 37.39,32.66 37.39,29.52 34.39,26.52 31.75,26.52 25.78,20.55 21.62,20.55 21.16,20.09 7.44,20.09 3.7,23.83 3.7,50.46 5.96,52.72 5.96,53.91 7.68,55.64 11.57,55.64 12.92,54.29 v1(12.92,53.95)
  Bottom Layer w0.254: v1(62.03,41.91) 62.48,42.37 62.48,43.03 C91.2
CLDO3: length 312.1
  VCC w0.254: v3(96.11,51.65) 97.16,52.69 97.16,64.57 97.54,64.95 97.54,67.97 97.05,68.45 95.17,68.45 91.69,71.93 78.54,71.93 76.2,69.6 68.71,69.6 67.13,68.02 63.7,68.02 62.56,66.88 57.8,66.88 v1(56.73,65.81)
  VCC w0.381: v1(12.92,55.07) 13.23,55.07 14,55.83 24.23,55.83 29.87,61.47 47.52,61.47 52.12,56.87 53.34,56.87 54.18,56.03 56.93,56.03 57.4,55.56 57.4,54.15 57.94,53.62 57.94,52.65 58.44,52.15
  VCC w0.508: 3.1,50.98 5.36,53.24 5.36,54.48 7.05,56.18 11.8,56.18 v1(12.92,55.07) ; v3(96.11,51.65) 95.68,51.22 95.68,44.76 90.2,39.27 90.2,38.18 91.54,36.83 91.54,29.57 90.55,28.58 v1(83.19,28.58) 82.7,28.58 v1(82.68,28.55)
  VCC w0.635: v1(60.53,25.91) v1(60.07,25.91) 58.62,27.36 39.57,27.36 39.6,27.38 v1(39.6,33.17)
  VCC w0.762: 3.1,50.98 2.97,50.85 2.97,23.29 6.78,19.48 25.81,19.48 v1(29.13,22.81) 32.06,25.73 37.95,25.73 39.57,27.36
  Inner5 w0.508: v1(60.07,25.91) v1(60.53,25.91) 60.93,25.91 61.72,25.12 70.97,25.12 74.42,28.58 v1(83.19,28.58)
  Bottom Layer w0.152: v1(39.6,33.17) 40,32.77 C229.2 C235.2 ; v1(95.72,46.76) C228.1 C234.1
  Bottom Layer w0.254: 57.38,66.27 57.49,66.27 ; 57.38,66.27 57.28,66.17 ; 57.38,66.27 57.19,66.27 v1(56.73,65.81) R75.2 ; 57.38,66.27 57.96,66.85 63.02,66.85 64.57,68.4 65.33,68.4 65.57,68.16 R73.2 65.57,67.4 66.78,66.19 R74.2 ; D20.1 v3(96.11,51.65) 96.11,55.25 96.88,56.01 96.88,57.12 98.56,58.81 SIM1.4 ; C230.2 39.4,32.97 v1(39.6,33.17) ; C102.2 v1(58.44,52.15)
CPUSLDO: length 46.8
  Bottom Layer w0.203: v1(15.14,53.92) 15.14,54 16.28,55.14 47.17,55.14 51.1,51.21 51.1,50.62 51.44,50.29 51.79,50.29 52.32,50.83 57.18,50.83 57.81,50.19 58.26,50.19 v1(58.44,50.37)
CPUX-RX: length 118.4
  内层2 w0.102: 18.06,73.23 19.33,71.96 19.33,69.29 20.22,68.4 63.55,68.4 64.21,67.74 82.17,67.74 82.91,68.48 86.61,68.48 87.66,67.44
  VCC w0.102: v1(74.93,45.52) 74.93,47.8 80.42,53.29 80.42,65.3 82.45,67.34 83.59,67.34 84.23,66.7 87.25,66.7 87.66,67.11 v1(87.66,67.43)
  内层4 w0.102: v3(62.95,42.15) 63.81,43 66.09,43 66.6,43.51 69.9,43.51 71.07,44.68 73.89,44.68 74.73,45.52 v1(74.93,45.52)
CPUX-TX: length 113.6
  内层2 w0.102: 15.52,73.23 16.87,71.88 16.87,69.85 17.35,69.37 18.82,69.37 20.04,68.15 63.37,68.15 64.06,67.46 82.32,67.46 83.08,68.22 84,68.22 84.4,67.82 v1(84.4,67.34)
  VCC w0.102: v1(74.42,45.8) 74.63,46 74.63,48.03 80.09,53.49 80.09,65.46 82.25,67.62 83.74,67.62 84.01,67.34 v1(84.4,67.34)
  内层4 w0.102: v1(74.42,45.8) 74.42,45.64 73.71,44.93 70.92,44.93 69.77,43.79 66.47,43.79 65.94,43.26 63.56,43.26 v3(62.95,42.64)
CPVDD: length 0.7
  Bottom Layer w0.152: C105.2 55.92,55.85 v3(55.92,55.15)
CPVEE: length 2.3
  Bottom Layer w0.152: v3(54.94,55.19) 55.4,55.65 C115.2 55.45,55.79 55.45,54.99 55.79,54.65 v3(55.92,54.65)
CTP-INT: length 67.4
  Inner5 w0.127: v3(25.1,23.72) 25.43,24.05 25.43,29.29 28.6,32.46 42.57,32.46 45.21,35.1 60.93,35.1 62.26,36.42 v3(63.35,36.42)
  Bottom Layer w0.127: v3(25.1,23.72) 19.94,23.72 18.21,22 7.67,22 6.45,20.78 FPC1.35
CTP-RST: length 75.5
  内层2 w0.127: v3(62.95,41.65) 62.95,39.61 62.51,39.17 62.51,38.23 60.43,36.14 55.63,36.14 53.06,33.58 42.88,33.58 41.94,34.52 40.59,34.52 39.93,33.86 39.4,33.86 39.17,34.09 39.17,34.65 38.61,35.2 37.62,35.2 36.68,36.14 36.68,36.14 30.61,36.14 26.77,32.31 26.77,26.7 26.31,26.24 26.31,24.21 25.37,23.27 v3(24.69,23.27)
  Bottom Layer w0.127: v3(24.69,23.27) 20.17,23.27 18.49,21.59 7.87,21.59 6.56,20.28 FPC1.36
CTP-SCK: length 67.5
  Inner5 w0.127: v3(63.09,35.97) 62.36,35.97 61.06,34.67 45.44,34.67 42.8,32.03 28.73,32.03 25.78,29.08 25.78,23.67 24.84,22.73 24.36,22.73 v3(24.26,22.83)
  Bottom Layer w0.127: FPC1.37 6.65,19.78 8.08,21.21 18.8,21.21 20.42,22.83 v3(24.26,22.83)
CTP-SDA: length 67.2
  Inner5 w0.127: v3(23.83,22.38) 23.93,22.28 24.97,22.28 26.14,23.44 26.14,28.88 28.88,31.62 42.98,31.62 45.59,34.24 61.42,34.24 v3(62.74,35.56)
  Bottom Layer w0.127: FPC1.38 6.68,19.28 8.2,20.8 19.08,20.8 20.65,22.38 v3(23.83,22.38)
DCDC1: length 4.6
  Bottom Layer w0.254: 60.16,46.86 C41.1 60.16,46.43 ; 60.16,46.86 v1(60.44,47.15) 60.44,47.65 ; 60.16,46.86 60.16,46.93 v1(59.94,47.15) 59.94,47.68 C36.1 C37.1 59.4,47.74 C40.1 ; C39.1 60.82,47.65 60.44,47.65 ; 60.16,46.43 60.16,46.36 v1(59.94,46.15) ; 60.16,46.43 v1(60.44,46.15) ; C38.1 60.44,47.66 60.44,47.65
  vias: v3(11.89,47.68) v3(11.89,46.96) v3(11.89,46.34) v3(12.4,47.26) v3(12.4,46.66) v3(12.4,46.13)
DCDC2: length 10.9
  Bottom Layer w0.152: 66.32,52.15 C214.2 ; 66.32,52.15 66.43,52.03 66.43,51.61 ; 66.32,52.15 C213.2
  Bottom Layer w0.254: v3(62.94,50.65) 62.94,51.13 ; 62.94,51.13 C76.1 ; 62.94,51.13 63.41,51.13 C75.1 ; C77.1 61.95,51.12 v3(61.95,50.67) ; 62.43,46.98 62.46,46.95 v1(62.46,46.63) v1(62.46,46.18) 62.95,46.18 C48.1 v1(62.97,46.63) C49.1 ; v3(62.46,50.65) 62.46,51.13 C78.1 ; 65.77,51.6 C216.2 C215.2 C68.1 C67.1 C57.1 65.86,48.96 v1(65.86,48.65) 65.86,48.58 C58.1 ; 65.77,51.6 66.42,51.6 66.43,51.61 ; 65.77,51.6 C211.2 C213.2 ; v3(61.95,49.61) 62.1,49.61 62.42,49.29 C47.1 62.43,49.06 v1(62.43,48.62)
  vias: v1(61.95,48.16) v1(63.96,48.13) v3(6.22,58.29) v3(6.76,58.29) v3(7.77,58.98) v3(7.77,58.5) v3(8.31,58.98) v3(8.33,58.5)
DCDC3: length 90.1
  内层4 w0.076: 38.14,40.95 38.23,41.88 38.23,42.16 37.97,42.29 v2(37.18,42.16)
  内层4 w0.102: v2(37.16,40.87) 37.23,40.95 38.96,40.95 v2(39.37,40.54)
  内层4 w0.254: v2(58.43,48.14) 54.85,48.14 54.46,48.54 52.58,48.54 45.39,55.73 19.68,55.73 16.61,58.8 14.45,58.8 13.74,59.51 11.15,59.51 9.88,58.24 9.88,54.28 v3(10.06,54.1)
  Bottom Layer w0.203: v2(38.12,49.91) v2(37.59,49.91) ; 34.67,47.98 34.67,47.75 v2(34.86,47.56) ; 40.89,47.9 40.89,48.28 v2(41,48.39) ; v2(41.48,54.53) 41.42,54.48 41.42,54.31
  Bottom Layer w0.254: 36.6,42.06 37.08,42.06 v2(37.18,42.16) ; 33.79,40.66 34.39,41.25 34.61,41.25 v2(34.63,41.26) ; v2(35.48,46.63) 35.94,46.63 36.07,46.76 ; v2(34.57,50.94) 34.62,50.99 35.59,50.99 ; 39.27,39.95 39.27,40.44 v2(39.37,40.54) ; v2(43.2,52.4) 43.17,52.36 43.17,51.87 ; 43.83,44.22 43.83,44.1 v2(44.19,43.74) ; 39.02,54.28 38.73,54.28 v2(38.43,54.58) ; v2(37.06,53.26) 37.06,52.43 v2(37.11,52.37) ; v2(32.26,48.92) 32.54,49.2 33.6,49.2 v2(33.73,49.07) ; v2(34.67,43.87) C117.1 ; 40.01,39.27 40.01,39.7 v2(39.87,39.85) ; v2(37.16,40.87) 37.08,40.95 36.43,40.95 ; R38.2 59.41,44.62 v2(59.43,44.64) ; v2(37.07,44.7) 37.49,44.28 37.49,44.07 v2(37.16,43.74) ; v2(42.59,42.19) 42.59,42.34 42.95,42.7 43.2,42.7 ; 34.75,53.7 v2(35.41,53.7) ; v2(37.05,49.87) 37.58,49.34 37.72,49.34 37.72,49.78 v2(37.59,49.91) ; 39.8,41.91 v2(39.39,41.91)
  Bottom Layer w0.305: v2(59.93,44.64) v2(60.43,44.64) ; v2(59.93,44.64) 59.94,44.63 59.94,44.22 ; v2(59.93,44.64) v2(59.43,44.64) v2(58.93,44.64) ; v2(60.43,44.64) v2(60.43,44.14) ; v2(60.43,44.64) 60.43,45.13 v2(60.43,45.14) ; 58.43,47.14 57.96,47.14 ; 57.98,45.52 57.98,45.1 v2(58.43,44.64) ; 57.98,45.52 58.31,45.52 v2(58.43,45.64) ; 57.98,45.52 57.96,45.53 57.96,46.63 58.42,46.63 v2(58.43,46.64) ; C119.2 58.93,44.25 v2(58.93,44.64) ; C155.2 58.43,44.26 v2(58.43,44.64) ; 57.96,47.65 58.43,47.65 v2(58.43,47.64) v2(58.43,48.14) ; v2(58.43,44.64) v2(58.93,44.64)
  vias: v2(32.97,52.3) v2(32.97,41.99) v2(33.01,45.14) v2(33.14,47.73) v2(33.07,45.92) v2(35.68,39.78) v2(35.85,54.44) v2(37.84,52.98) v2(38.53,51.46) v2(38.5,43.74) v2(39.37,44.52) v2(40.18,43.31) v2(40.99,50.39) v2(40.99,46) v2(40.99,40.56) v2(42.57,48.18) v2(42.64,46.08) v2(43.66,49.45) v2(58.43,47.14) v3(11.4,57.96) v3(11.38,57.28) v3(11.86,57.28) v3(11.86,56.72) v3(11.89,57.96) v3(12.37,57.25)
DSP-UART-RX: length 19.9
  Bottom Layer w0.102: 56.16,73.23 56.16,73.1 54.91,71.86 54.91,69.95 54.15,69.19 54.15,61.6 52.27,59.72 52.27,58.22 52.4,58.09 52.4,57.34 52.92,56.82 53.26,56.82 53.49,56.59 53.49,55.73 v1(53.44,55.68)
DSP-UART-TX: length 13.8
  Bottom Layer w0.102: 53.62,70.69 53.87,70.43 53.87,61.77 51.94,59.84 v1(51.94,57.76)
EDP-AUXN: length 12.2
  内层2 w0.127: v3(49.66,25.82) 49.45,25.62 49.45,25.4 49.58,25.27 49.89,25.27 50.02,25.4 50.02,25.68 50.15,25.81 50.27,25.81 50.4,25.68 50.4,25.4 50.53,25.27 50.66,25.27 50.78,25.4 50.78,25.68 50.91,25.81 51.04,25.81 51.16,25.68 51.16,25.4 51.29,25.27 52.04,25.27 52.29,25.03 58.08,25.03 58.93,25.88 v3(58.93,26.09)
EDP-AUXP: length 11.2
  内层2 w0.127: v3(49.12,25.82) 49.22,25.72 49.22,25.28 49.51,24.99 52,24.99 52.19,24.8 58.17,24.8 59.08,25.71 59.23,25.71 v3(59.26,25.68)
